# EasyEDA Pro project Access Control Core.eprj, schematic Schematic1
Board Name: RGB Light Bar; Create Date: 2026-01-17; Page Name: P1; Project Name: ACS Core; Schematic Name: Schematic1; Update Date: 2026-01-18; Company: EasyEDA.com; Page Size: A4; Version: V1.0
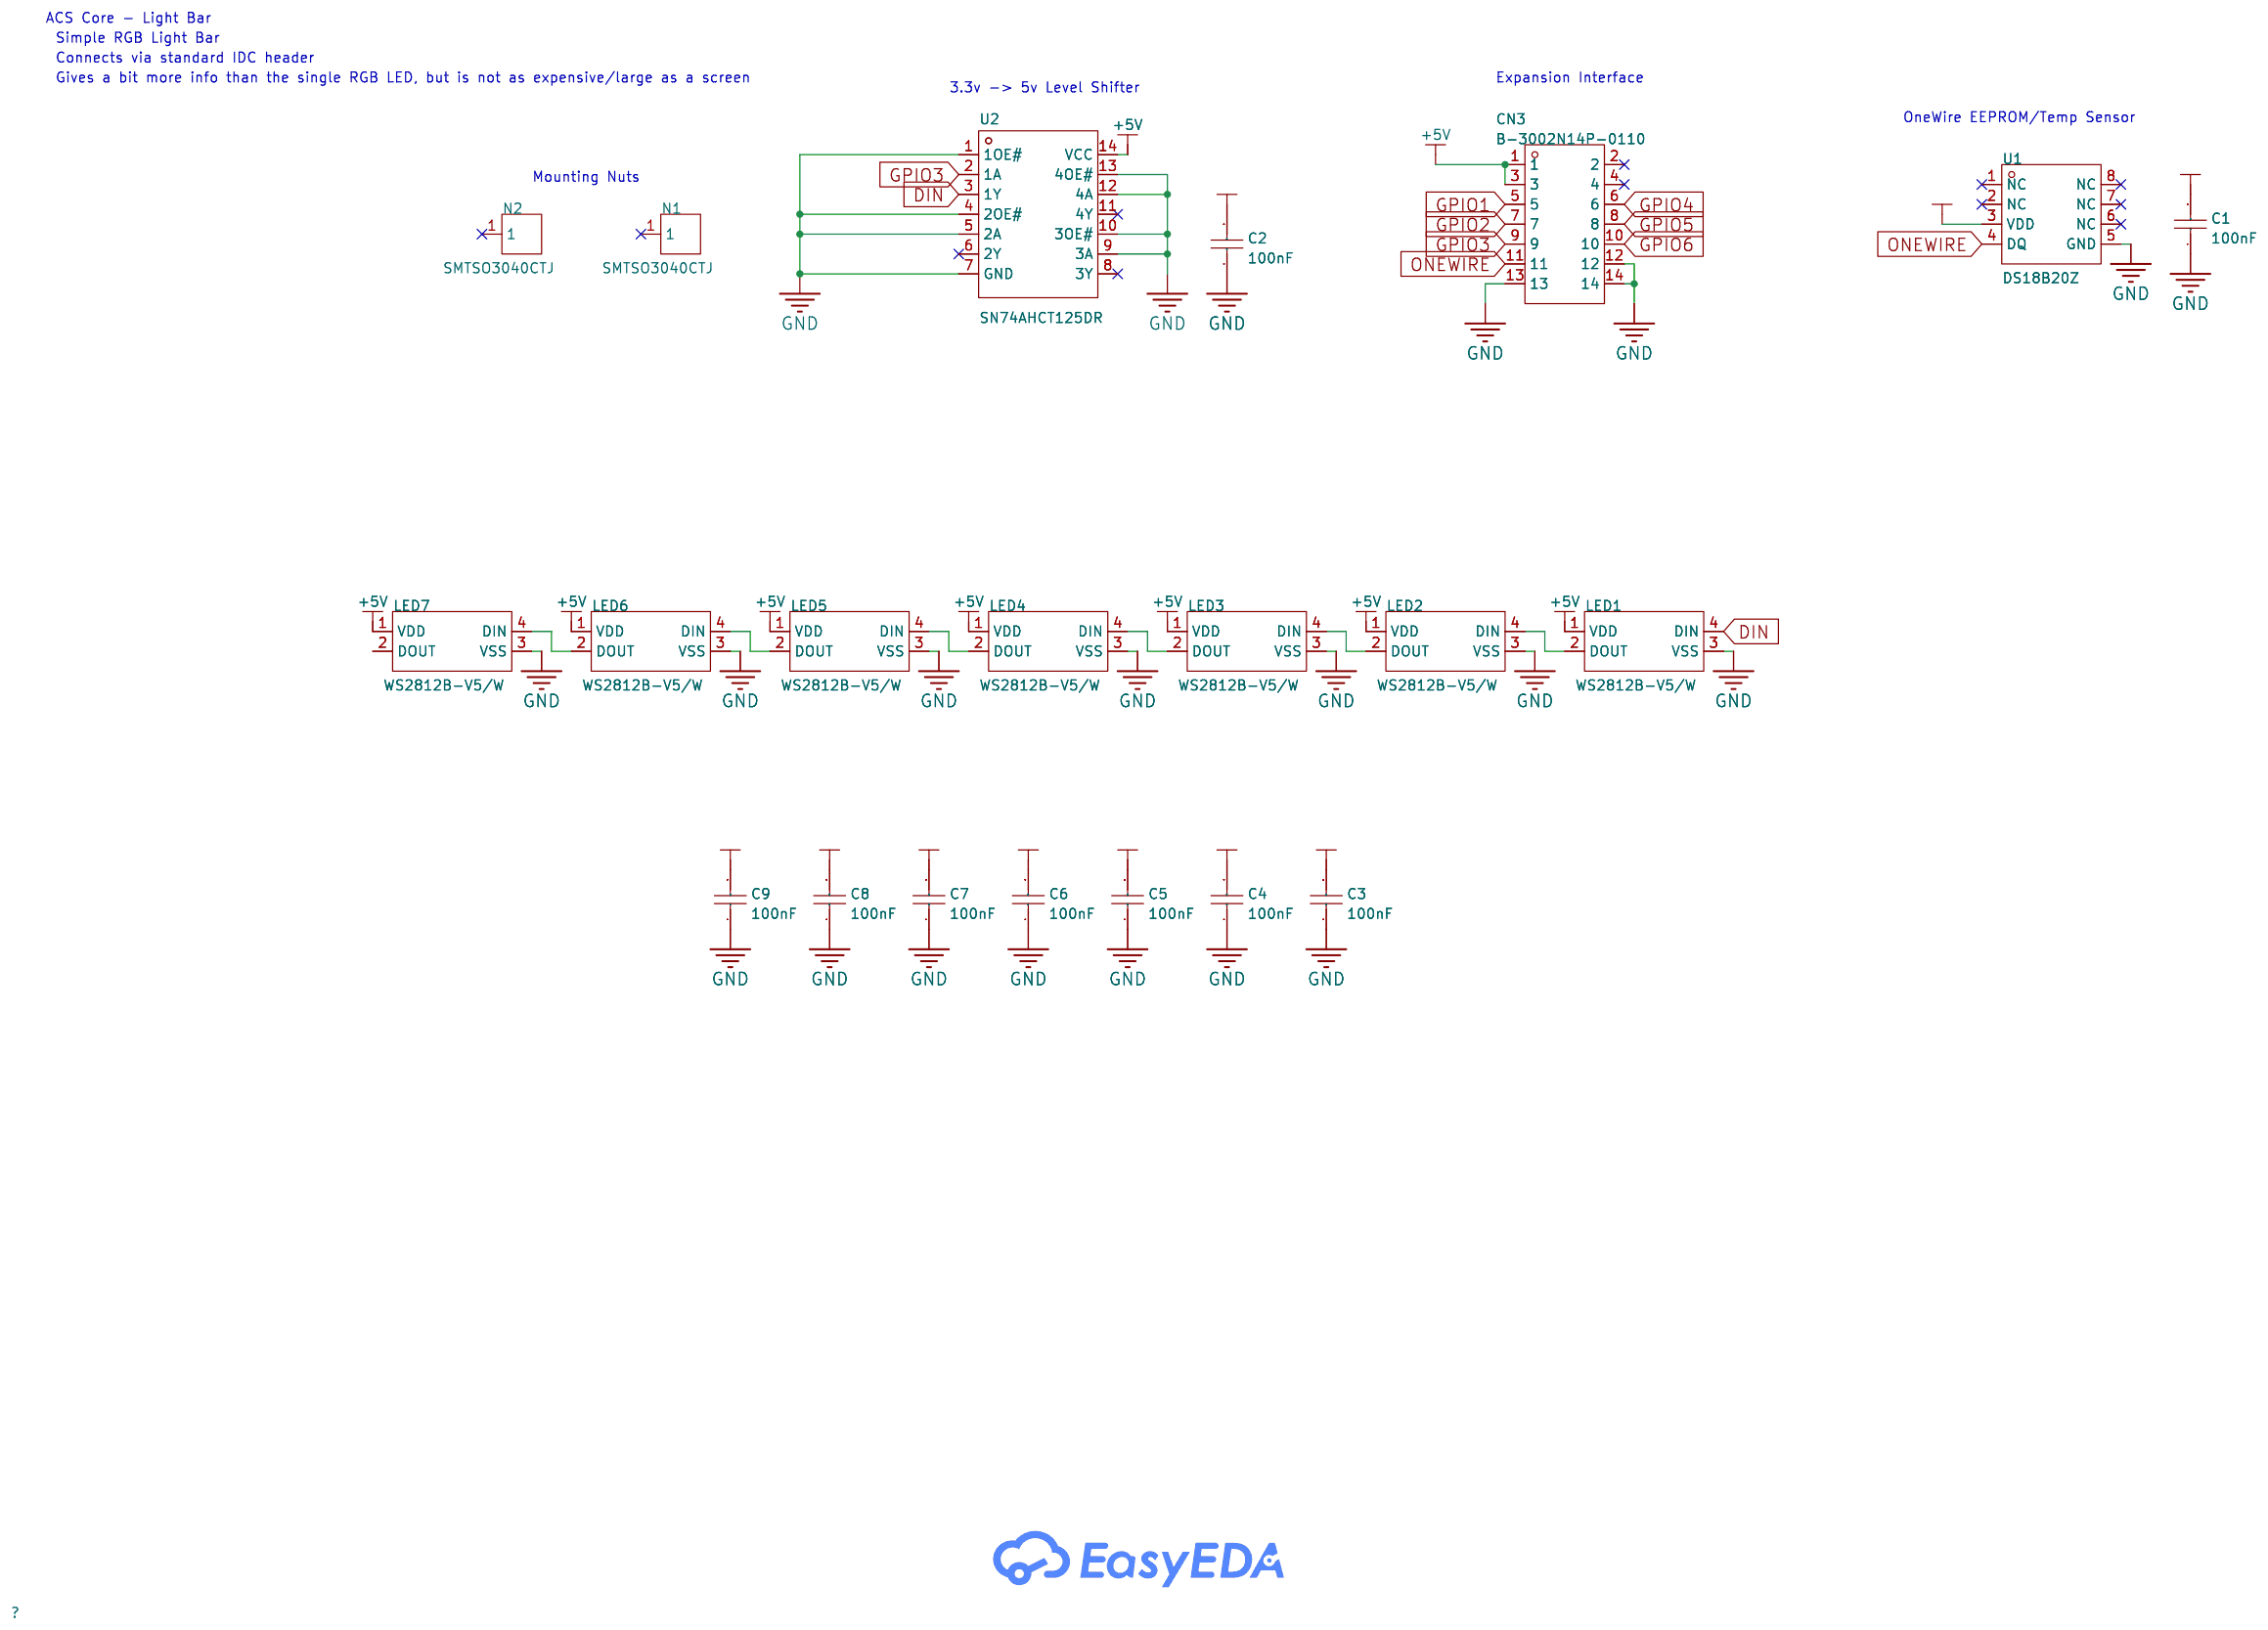
[diagram p10: schematic sheet]

## Parts
C1  100nF  [C0805]
C2  100nF  [C0805]
C3  100nF  [C0805]
C4  100nF  [C0805]
C5  100nF  [C0805]
C6  100nF  [C0805]
C7  100nF  [C0805]
C8  100nF  [C0805]
C9  100nF  [C0805]
CN3  B-3002N14P-0110  [IDC-SMD_14P-P2.00_B-3002N14P-0110]
LED1  WS2812B-V5/W  [LED-SMD_4P-L5.0-W5.0-TL-1]
LED2  WS2812B-V5/W  [LED-SMD_4P-L5.0-W5.0-TL-1]
LED3  WS2812B-V5/W  [LED-SMD_4P-L5.0-W5.0-TL-1]
LED4  WS2812B-V5/W  [LED-SMD_4P-L5.0-W5.0-TL-1]
LED5  WS2812B-V5/W  [LED-SMD_4P-L5.0-W5.0-TL-1]
LED6  WS2812B-V5/W  [LED-SMD_4P-L5.0-W5.0-TL-1]
LED7  WS2812B-V5/W  [LED-SMD_4P-L5.0-W5.0-TL-1]
N1  SMTSO3040CTJ  [SMD-1_BD5.5-D4.0_H4.0]
N2  SMTSO3040CTJ  [SMD-1_BD5.5-D4.0_H4.0]
U1  DS18B20Z  [SOP-8_L4.9-W3.9-P1.27-LS6.0-BL]
U2  SN74AHCT125DR  [SOIC-14_L8.7-W3.9-P1.27-LS6.0-BL]

## Library data of the parts
C1-C9 = CL21B104KCFNNNE: LCSC Part Name: 100nF ±10% 100V; Supplier Part: C28233; Manufacturer: SAMSUNG(三星); Supplier Footprint: 0805; Datasheet: https://item.szlcsc.com/datasheet/CL21B104KCFNNNE/28983.html; Supplier: LCSC; Tolerance: ±10%; Voltage Rating: 100V; Temperature Coefficient: X7R
CN3 = B-3002N14P-0110: LCSC Part Name: 2mm 2x7P 排数:2 每排P数:7; Supplier Part: C383681; Manufacturer: Ckmtw(灿科盟); Supplier Footprint: SMD,P=2mm; JLCPCB Part Class: Extended Part; Datasheet: https://item.szlcsc.com/datasheet/B-3002N14P-0110/356941.html; Supplier: LCSC; Connector Type: IDC Header; Pitch: 2mm; Number of Positions or Pins: 2x7P; Holder Type: Surface Mount,Vertical; Row Spacing: 2mm; Number of Rows: 2; Number of PINs Per Row: 7; Contact Material: Brass; Contact Plating: Gold
LED1-LED7 = WS2812B-V5/W: LCSC Part Name: RGB三色; Supplier Part: C2874885; Manufacturer: worldsemi; Supplier Footprint: SMD5050; JLCPCB Part Class: Extended Part; Datasheet: https://atta.szlcsc.com/upload/public/pdf/source/20241202/615CE05766148E9C4DD7D8CE8DBC7337.pdf; Supplier: LCSC
N1 N2 = SMTSO3040CTJ: LCSC Part Name: 雄和远景，电路板表贴圆螺母柱，M3X4，铜镀锡,1个; Supplier Part: C2915635; Manufacturer: Sinhoo(雄和远景); Datasheet: https://atta.szlcsc.com/upload/public/pdf/source/20211122/17CF5E24EB4D4DC090A80DE3D7DE5E21.pdf; Supplier: LCSC; specifications: M3X4; surface treatment: 镀锡
U1 = DS18B20Z: Resolution:±0.4℃ Resolution:±0.4℃ Supply Voltage:2.5V~5.5V Supply Voltage:2.5V~5.5V; LCSC Part Name: 温度传感器; Supplier Part: C695837; Manufacturer: UMW(友台半导体); Supplier Footprint: SOIC-8; JLCPCB Part Class: Extended Part; Datasheet: https://atta.szlcsc.com/upload/public/pdf/source/20231109/DC3DA9D47D486EF40A6E0F08B9A498E3.pdf; Supplier: LCSC; Resolution: ±0.4℃; Supply Voltage: 2.5V~5.5V
U2 = SN74AHCT125DR: LCSC Part Name: 三态输出，四路总线缓冲门; Supplier Part: C155176; Manufacturer: TI(德州仪器); Supplier Footprint: SOIC-14; Datasheet: https://www.ti.com/cn/lit/gpn/sn74ahct125; Supplier: LCSC; output type: Tri-State; Voltage - Supply: 4.5V~5.5V; Number of Elements: 4; Number of Bits per Element: 1; Current - Output Low(IOL): 8mA; Current - Output High(IOH): 8mA; Logic Family: 74AHCT; Operating Temperature: -40℃~+85℃; Quiescent Current: 20uA; Propagation Delay: 7.5ns@5V,50pF

## Nets
+5V: C1.2 C2.2 C3.2 C4.2 C5.2 C6.2 C7.2 C8.2 C9.2 CN3.1 CN3.3 LED1.1(VDD) LED2.1(VDD) LED3.1(VDD) LED4.1(VDD) LED5.1(VDD) LED6.1(VDD) LED7.1(VDD) U1.3(VDD) U2.14(VCC)
GND: C1.1 C2.1 C3.1 C4.1 C5.1 C6.1 C7.1 C8.1 C9.1 CN3.12 CN3.13 CN3.14 LED1.3(VSS) LED2.3(VSS) LED3.3(VSS) LED4.3(VSS) LED5.3(VSS) LED6.3(VSS) LED7.3(VSS) U1.5(GND) U2.1(1OE#) U2.4(2OE#) U2.5(2A) U2.7(GND) U2.9(3A) U2.10(3OE#) U2.12(4A) U2.13(4OE#)
DIN: LED1.4(DIN) U2.3(1Y)
GPIO1: CN3.5
GPIO2: CN3.7
GPIO3: CN3.9 U2.2(1A)
GPIO4: CN3.6
GPIO5: CN3.8
GPIO6: CN3.10
ONEWIRE: CN3.11 U1.4(DQ)
$1N1285: LED1.2(DOUT) LED2.4(DIN)
$1N1388: LED2.2(DOUT) LED3.4(DIN)
$1N1465: LED3.2(DOUT) LED4.4(DIN)
$1N1542: LED4.2(DOUT) LED5.4(DIN)
$1N1619: LED5.2(DOUT) LED6.4(DIN)
$1N4210: LED6.2(DOUT) LED7.4(DIN)

Not connected (* = marked no-connect by the designer): CN3 2* 4*; LED7 2(DOUT); N1 1*; N2 1*; U1 1(NC)* 2(NC)* 6(NC)* 7(NC)* 8(NC)*; U2 6(2Y)* 8(3Y)* 11(4Y)*

## Notes on the sheet
- ACS Core - Light Bar
- Simple RGB Light Bar
- Connects via standard IDC header
- Gives a bit more info than the single RGB LED, but is not as expensive/large as a screen
- 3.3v -> 5v Level Shifter
- Expansion Interface
- OneWire EEPROM/Temp Sensor
- Mounting Nuts
